# Altium schematic sheet ZYNQ_US_SOC_PL_FPGA_Banks_66_67_68_FMC.SchDoc
size 419 x 296 mm
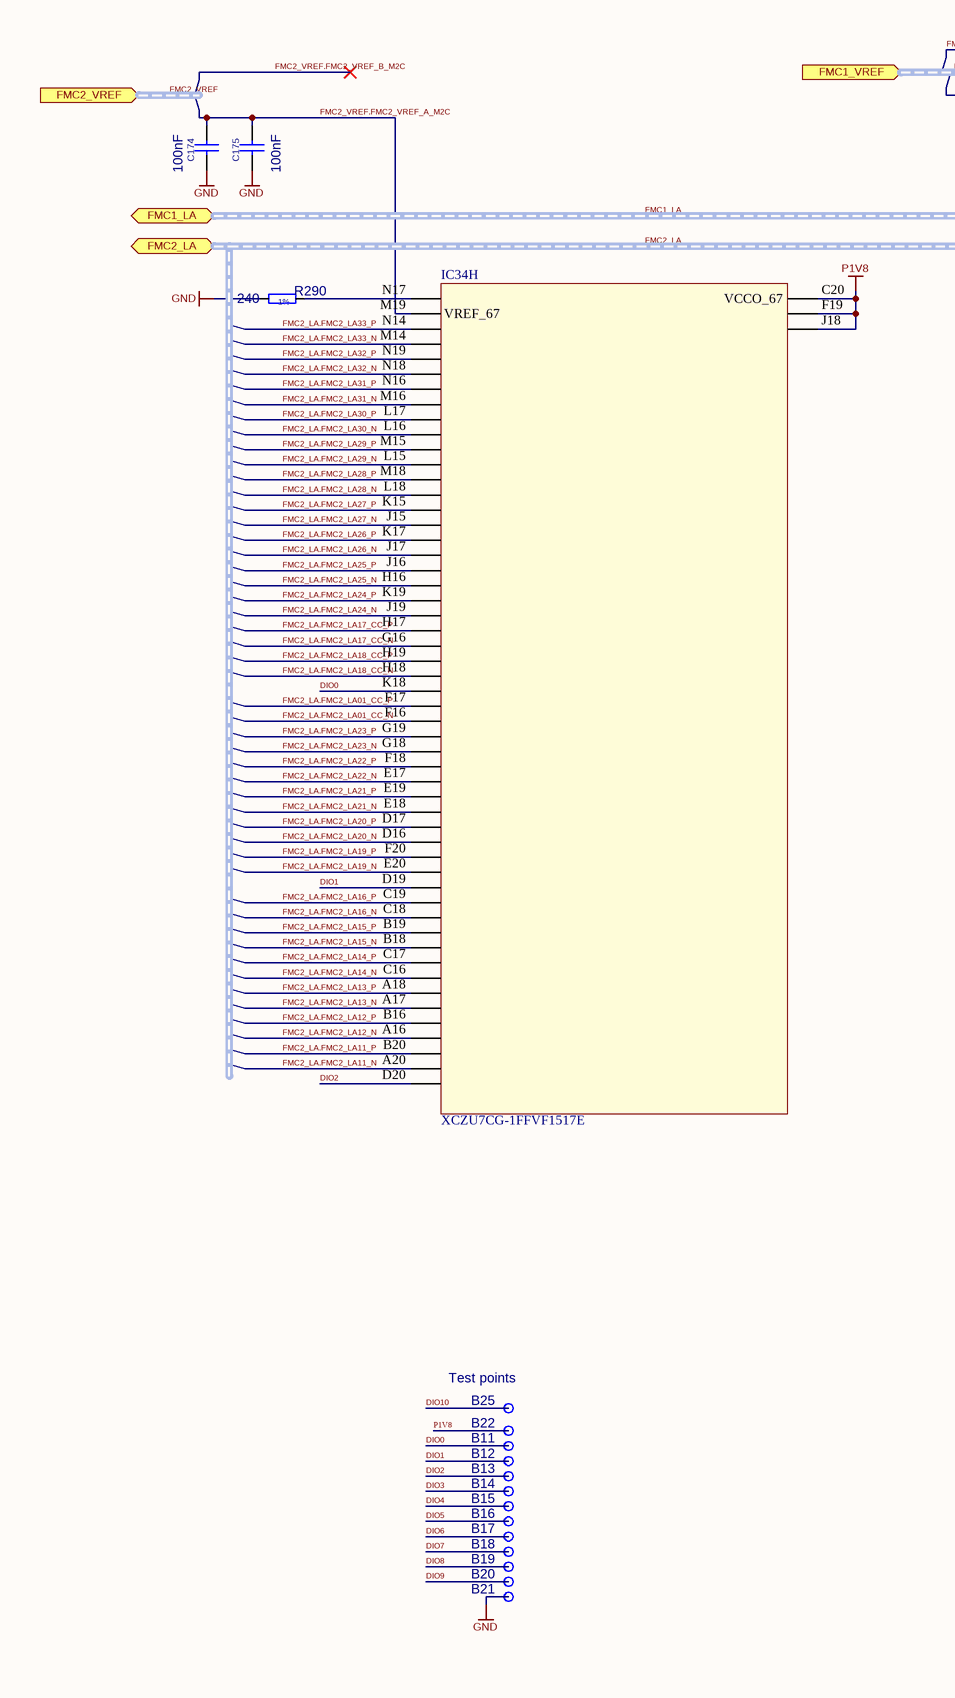
[diagram p0: ZYNQ_US_SOC_PL_FPGA_Banks_66_67_68_FMC.SchDoc, left]
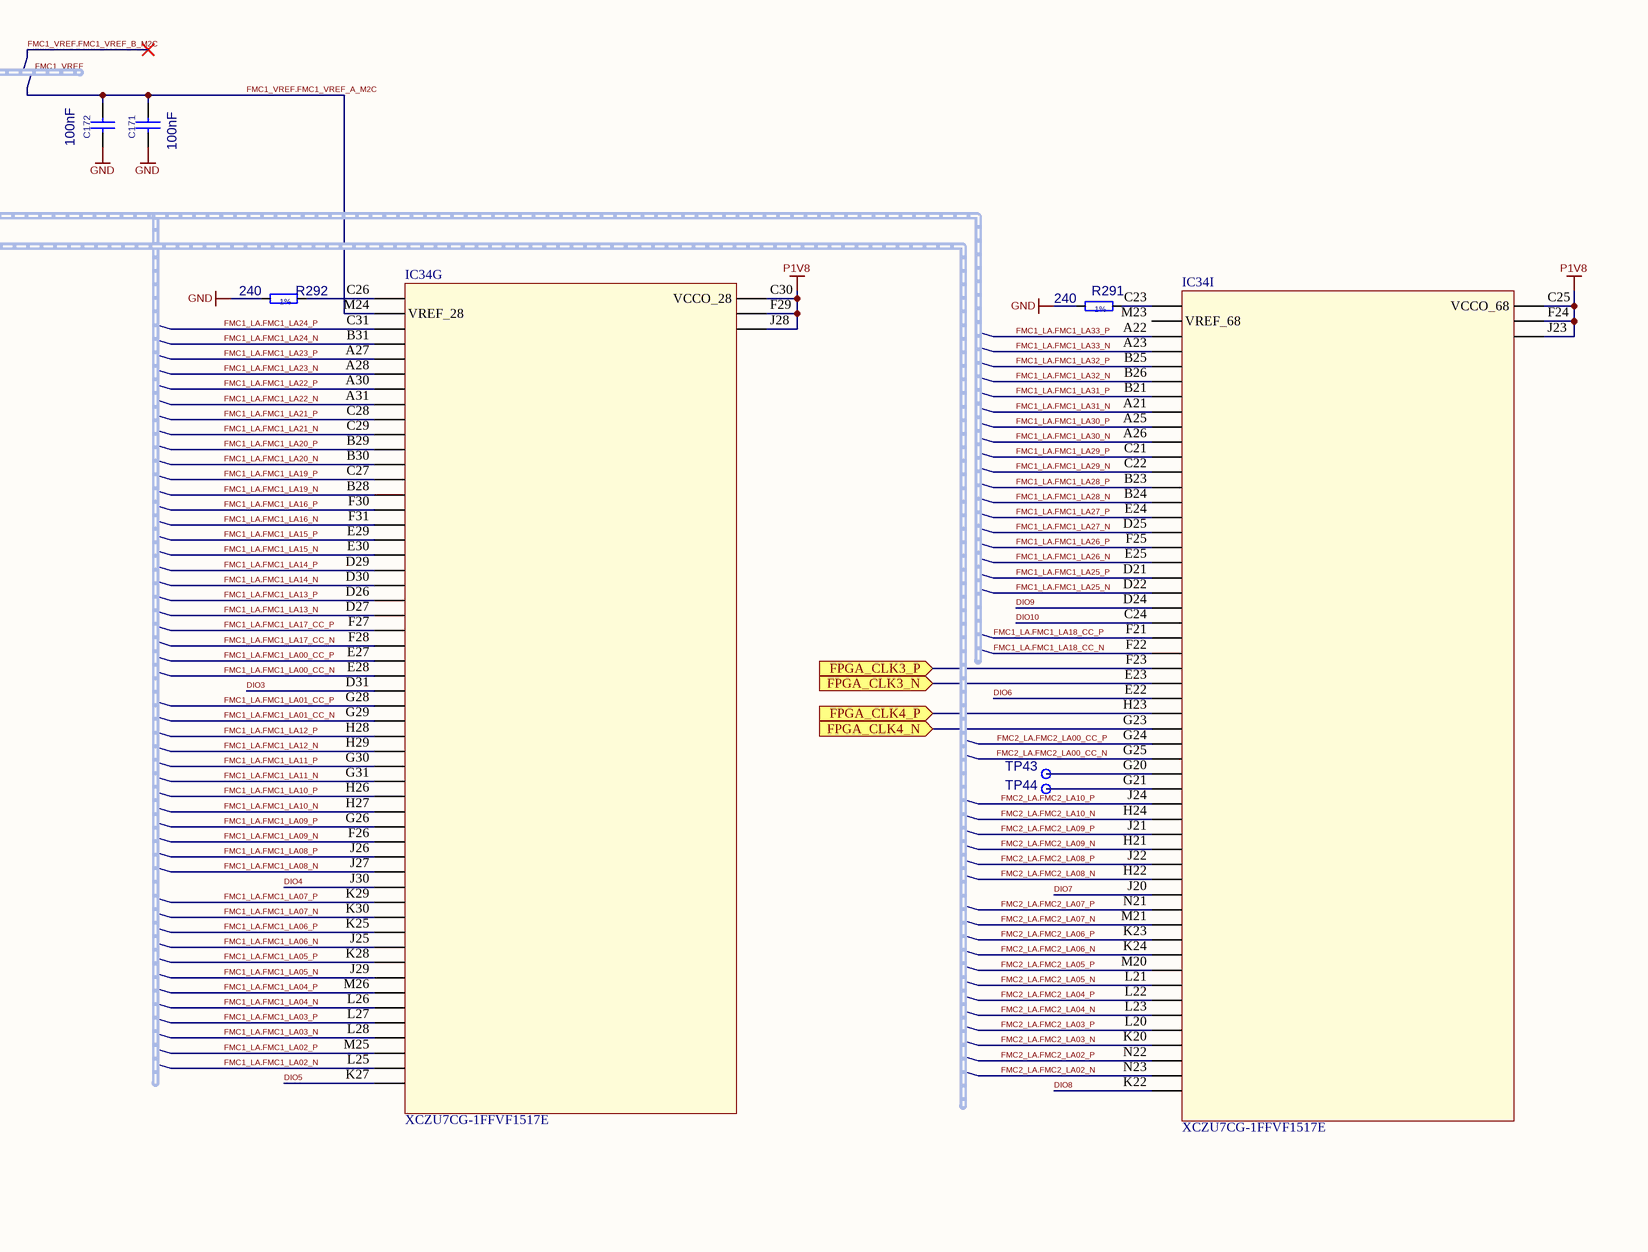
[diagram p1: ZYNQ_US_SOC_PL_FPGA_Banks_66_67_68_FMC.SchDoc, right]

## Parts
B11  SMD_PAD_D1MM  [C100]  (value not drawn)
B12  SMD_PAD_D1MM  [C100]  (value not drawn)
B13  SMD_PAD_D1MM  [C100]  (value not drawn)
B14  SMD_PAD_D1MM  [C100]  (value not drawn)
B15  SMD_PAD_D1MM  [C100]  (value not drawn)
B16  SMD_PAD_D1MM  [C100]  (value not drawn)
B17  SMD_PAD_D1MM  [C100]  (value not drawn)
B18  SMD_PAD_D1MM  [C100]  (value not drawn)
B19  SMD_PAD_D1MM  [C100]  (value not drawn)
B20  SMD_PAD_D1MM  [C100]  (value not drawn)
B21  SMD_PAD_D1MM  [C100]  (value not drawn)
B22  SMD_PAD_D1MM  [C100]  (value not drawn)
B25  SMD_PAD_D1MM  [C100]  (value not drawn)
C171  value 100nF  [CAPC0603X33N]  (hidden comment: Capacitor - non polarized CAPC0603X33N)
C172  value 100nF  [CAPC0603X33N]  (hidden comment: Capacitor - non polarized CAPC0603X33N)
C174  value 100nF  [CAPC0603X33N]  (hidden comment: Capacitor - non polarized CAPC0603X33N)
C175  value 100nF  [CAPC0603X33N]  (hidden comment: Capacitor - non polarized CAPC0603X33N)
IC34  XCZU7CG-1FFVF1517E  (parts G,H,I of 26)
R290  value 240  (hidden comment: Resistor - 1% RESC1005X40N)
R291  value 240  (hidden comment: Resistor - 1% RESC1005X40N)
R292  value 240  (hidden comment: Resistor - 1% RESC1005X40N)
TP43  SMD_PAD_D1MM  [C100]  (value not drawn)
TP44  SMD_PAD_D1MM  [C100]  (value not drawn)

## Ports
FMC1_LA (bidir, harness FMC1_LA), FMC1_VREF (in, harness FMC1_VREF), FMC2_LA (bidir, harness FMC2_LA), FMC2_VREF (in, harness FMC2_VREF), FPGA_CLK3_N (in), FPGA_CLK3_P (in), FPGA_CLK4_N (in), FPGA_CLK4_P (in)

## Nets
GND: B21.1 C171.2 C172.2 C174.2 C175.2 R290.1 R291.1 R292.1
P1V8: B22.1 IC34.C20(VCCO_67) IC34.C25(VCCO_68) IC34.C30(VCCO_28) IC34.F19(VCCO_67_1) IC34.F24(VCCO_68_1) IC34.F29(VCCO_28_1) IC34.J18(VCCO_67_2) IC34.J23(VCCO_68_2) IC34.J28(VCCO_28_2)
DIO0: B11.1 IC34.K18(IOB_X2Y233)
DIO1: B12.1 IC34.D19(IOB_X2Y246)
DIO2: B13.1 IC34.D20(IOB_X2Y259)
DIO3: B14.1 IC34.D31(IOB_X0Y285)
DIO4: B15.1 IC34.J30(IOB_X0Y298)
DIO5: B16.1 IC34.K27(IOB_X0Y311)
DIO6: B17.1 IC34.E22(IOB_X2Y285)
DIO7: B18.1 IC34.J20(IOB_X2Y298)
DIO8: B19.1 IC34.K22(IOB_X2Y311)
DIO9: B20.1 IC34.D24(IOB_X2Y279)
DIO10: B25.1 IC34.C24(IOB_X2Y280)
FMC1_LA.FMC1_LA00_CC_N: IC34.E28(IOB_X0Y284)
FMC1_LA.FMC1_LA00_CC_P: IC34.E27(IOB_X0Y283)
FMC1_LA.FMC1_LA01_CC_N: IC34.G29(IOB_X0Y287)
FMC1_LA.FMC1_LA01_CC_P: IC34.G28(IOB_X0Y286)
FMC1_LA.FMC1_LA02_N: IC34.L25(IOB_X0Y310)
FMC1_LA.FMC1_LA02_P: IC34.M25(IOB_X0Y309)
FMC1_LA.FMC1_LA03_N: IC34.L28(IOB_X0Y308)
FMC1_LA.FMC1_LA03_P: IC34.L27(IOB_X0Y307)
FMC1_LA.FMC1_LA04_N: IC34.L26(IOB_X0Y306)
FMC1_LA.FMC1_LA04_P: IC34.M26(IOB_X0Y305)
FMC1_LA.FMC1_LA05_N: IC34.J29(IOB_X0Y304)
FMC1_LA.FMC1_LA05_P: IC34.K28(IOB_X0Y303)
FMC1_LA.FMC1_LA06_N: IC34.J25(IOB_X0Y302)
FMC1_LA.FMC1_LA06_P: IC34.K25(IOB_X0Y301)
FMC1_LA.FMC1_LA07_N: IC34.K30(IOB_X0Y300)
FMC1_LA.FMC1_LA07_P: IC34.K29(IOB_X0Y299)
FMC1_LA.FMC1_LA08_N: IC34.J27(IOB_X0Y297)
FMC1_LA.FMC1_LA08_P: IC34.J26(IOB_X0Y296)
FMC1_LA.FMC1_LA09_N: IC34.F26(IOB_X0Y295)
FMC1_LA.FMC1_LA09_P: IC34.G26(IOB_X0Y294)
FMC1_LA.FMC1_LA10_N: IC34.H27(IOB_X0Y293)
FMC1_LA.FMC1_LA10_P: IC34.H26(IOB_X0Y292)
FMC1_LA.FMC1_LA11_N: IC34.G31(IOB_X0Y291)
FMC1_LA.FMC1_LA11_P: IC34.G30(IOB_X0Y290)
FMC1_LA.FMC1_LA12_N: IC34.H29(IOB_X0Y289)
FMC1_LA.FMC1_LA12_P: IC34.H28(IOB_X0Y288)
FMC1_LA.FMC1_LA13_N: IC34.D27(IOB_X0Y280)
FMC1_LA.FMC1_LA13_P: IC34.D26(IOB_X0Y279)
FMC1_LA.FMC1_LA14_N: IC34.D30(IOB_X0Y278)
FMC1_LA.FMC1_LA14_P: IC34.D29(IOB_X0Y277)
FMC1_LA.FMC1_LA15_N: IC34.E30(IOB_X0Y276)
FMC1_LA.FMC1_LA15_P: IC34.E29(IOB_X0Y275)
FMC1_LA.FMC1_LA16_N: IC34.F31(IOB_X0Y274)
FMC1_LA.FMC1_LA16_P: IC34.F30(IOB_X0Y273)
FMC1_LA.FMC1_LA17_CC_N: IC34.F28(IOB_X0Y282)
FMC1_LA.FMC1_LA17_CC_P: IC34.F27(IOB_X0Y281)
FMC1_LA.FMC1_LA18_CC_N: IC34.F22(IOB_X2Y282)
FMC1_LA.FMC1_LA18_CC_P: IC34.F21(IOB_X2Y281)
FMC1_LA.FMC1_LA19_N: IC34.B28(IOB_X0Y271)
FMC1_LA.FMC1_LA19_P: IC34.C27(IOB_X0Y270)
FMC1_LA.FMC1_LA20_N: IC34.B30(IOB_X0Y269)
FMC1_LA.FMC1_LA20_P: IC34.B29(IOB_X0Y268)
FMC1_LA.FMC1_LA21_N: IC34.C29(IOB_X0Y267)
FMC1_LA.FMC1_LA21_P: IC34.C28(IOB_X0Y266)
FMC1_LA.FMC1_LA22_N: IC34.A31(IOB_X0Y265)
FMC1_LA.FMC1_LA22_P: IC34.A30(IOB_X0Y264)
FMC1_LA.FMC1_LA23_N: IC34.A28(IOB_X0Y263)
FMC1_LA.FMC1_LA23_P: IC34.A27(IOB_X0Y262)
FMC1_LA.FMC1_LA24_N: IC34.B31(IOB_X0Y261)
FMC1_LA.FMC1_LA24_P: IC34.C31(IOB_X0Y260)
FMC1_LA.FMC1_LA25_N: IC34.D22(IOB_X2Y278)
FMC1_LA.FMC1_LA25_P: IC34.D21(IOB_X2Y277)
FMC1_LA.FMC1_LA26_N: IC34.E25(IOB_X2Y276)
FMC1_LA.FMC1_LA26_P: IC34.F25(IOB_X2Y275)
FMC1_LA.FMC1_LA27_N: IC34.D25(IOB_X2Y274)
FMC1_LA.FMC1_LA27_P: IC34.E24(IOB_X2Y273)
FMC1_LA.FMC1_LA28_N: IC34.B24(IOB_X2Y271)
FMC1_LA.FMC1_LA28_P: IC34.B23(IOB_X2Y270)
FMC1_LA.FMC1_LA29_N: IC34.C22(IOB_X2Y269)
FMC1_LA.FMC1_LA29_P: IC34.C21(IOB_X2Y268)
FMC1_LA.FMC1_LA30_N: IC34.A26(IOB_X2Y267)
FMC1_LA.FMC1_LA30_P: IC34.A25(IOB_X2Y266)
FMC1_LA.FMC1_LA31_N: IC34.A21(IOB_X2Y265)
FMC1_LA.FMC1_LA31_P: IC34.B21(IOB_X2Y264)
FMC1_LA.FMC1_LA32_N: IC34.B26(IOB_X2Y263)
FMC1_LA.FMC1_LA32_P: IC34.B25(IOB_X2Y262)
FMC1_LA.FMC1_LA33_N: IC34.A23(IOB_X2Y261)
FMC1_LA.FMC1_LA33_P: IC34.A22(IOB_X2Y260)
FMC1_VREF.FMC1_VREF_A_M2C: C171.1 C172.1 IC34.M24(VREF_28)
FMC2_LA.FMC2_LA00_CC_N: IC34.G25(IOB_X2Y289)
FMC2_LA.FMC2_LA00_CC_P: IC34.G24(IOB_X2Y288)
FMC2_LA.FMC2_LA01_CC_N: IC34.F16(IOB_X2Y235)
FMC2_LA.FMC2_LA01_CC_P: IC34.F17(IOB_X2Y234)
FMC2_LA.FMC2_LA02_N: IC34.N23(IOB_X2Y310)
FMC2_LA.FMC2_LA02_P: IC34.N22(IOB_X2Y309)
FMC2_LA.FMC2_LA03_N: IC34.K20(IOB_X2Y308)
FMC2_LA.FMC2_LA03_P: IC34.L20(IOB_X2Y307)
FMC2_LA.FMC2_LA04_N: IC34.L23(IOB_X2Y306)
FMC2_LA.FMC2_LA04_P: IC34.L22(IOB_X2Y305)
FMC2_LA.FMC2_LA05_N: IC34.L21(IOB_X2Y304)
FMC2_LA.FMC2_LA05_P: IC34.M20(IOB_X2Y303)
FMC2_LA.FMC2_LA06_N: IC34.K24(IOB_X2Y302)
FMC2_LA.FMC2_LA06_P: IC34.K23(IOB_X2Y301)
FMC2_LA.FMC2_LA07_N: IC34.M21(IOB_X2Y300)
FMC2_LA.FMC2_LA07_P: IC34.N21(IOB_X2Y299)
FMC2_LA.FMC2_LA08_N: IC34.H22(IOB_X2Y297)
FMC2_LA.FMC2_LA08_P: IC34.J22(IOB_X2Y296)
FMC2_LA.FMC2_LA09_N: IC34.H21(IOB_X2Y295)
FMC2_LA.FMC2_LA09_P: IC34.J21(IOB_X2Y294)
FMC2_LA.FMC2_LA10_N: IC34.H24(IOB_X2Y293)
FMC2_LA.FMC2_LA10_P: IC34.J24(IOB_X2Y292)
FMC2_LA.FMC2_LA11_N: IC34.A20(IOB_X2Y258)
FMC2_LA.FMC2_LA11_P: IC34.B20(IOB_X2Y257)
FMC2_LA.FMC2_LA12_N: IC34.A16(IOB_X2Y256)
FMC2_LA.FMC2_LA12_P: IC34.B16(IOB_X2Y255)
FMC2_LA.FMC2_LA13_N: IC34.A17(IOB_X2Y254)
FMC2_LA.FMC2_LA13_P: IC34.A18(IOB_X2Y253)
FMC2_LA.FMC2_LA14_N: IC34.C16(IOB_X2Y252)
FMC2_LA.FMC2_LA14_P: IC34.C17(IOB_X2Y251)
FMC2_LA.FMC2_LA15_N: IC34.B18(IOB_X2Y250)
FMC2_LA.FMC2_LA15_P: IC34.B19(IOB_X2Y249)
FMC2_LA.FMC2_LA16_N: IC34.C18(IOB_X2Y248)
FMC2_LA.FMC2_LA16_P: IC34.C19(IOB_X2Y247)
FMC2_LA.FMC2_LA17_CC_N: IC34.G16(IOB_X2Y230)
FMC2_LA.FMC2_LA17_CC_P: IC34.H17(IOB_X2Y229)
FMC2_LA.FMC2_LA18_CC_N: IC34.H18(IOB_X2Y232)
FMC2_LA.FMC2_LA18_CC_P: IC34.H19(IOB_X2Y231)
FMC2_LA.FMC2_LA19_N: IC34.E20(IOB_X2Y245)
FMC2_LA.FMC2_LA19_P: IC34.F20(IOB_X2Y244)
FMC2_LA.FMC2_LA20_N: IC34.D16(IOB_X2Y243)
FMC2_LA.FMC2_LA20_P: IC34.D17(IOB_X2Y242)
FMC2_LA.FMC2_LA21_N: IC34.E18(IOB_X2Y241)
FMC2_LA.FMC2_LA21_P: IC34.E19(IOB_X2Y240)
FMC2_LA.FMC2_LA22_N: IC34.E17(IOB_X2Y239)
FMC2_LA.FMC2_LA22_P: IC34.F18(IOB_X2Y238)
FMC2_LA.FMC2_LA23_N: IC34.G18(IOB_X2Y237)
FMC2_LA.FMC2_LA23_P: IC34.G19(IOB_X2Y236)
FMC2_LA.FMC2_LA24_N: IC34.J19(IOB_X2Y228)
FMC2_LA.FMC2_LA24_P: IC34.K19(IOB_X2Y227)
FMC2_LA.FMC2_LA25_N: IC34.H16(IOB_X2Y226)
FMC2_LA.FMC2_LA25_P: IC34.J16(IOB_X2Y225)
FMC2_LA.FMC2_LA26_N: IC34.J17(IOB_X2Y224)
FMC2_LA.FMC2_LA26_P: IC34.K17(IOB_X2Y223)
FMC2_LA.FMC2_LA27_N: IC34.J15(IOB_X2Y222)
FMC2_LA.FMC2_LA27_P: IC34.K15(IOB_X2Y221)
FMC2_LA.FMC2_LA28_N: IC34.L18(IOB_X2Y219)
FMC2_LA.FMC2_LA28_P: IC34.M18(IOB_X2Y218)
FMC2_LA.FMC2_LA29_N: IC34.L15(IOB_X2Y217)
FMC2_LA.FMC2_LA29_P: IC34.M15(IOB_X2Y216)
FMC2_LA.FMC2_LA30_N: IC34.L16(IOB_X2Y215)
FMC2_LA.FMC2_LA30_P: IC34.L17(IOB_X2Y214)
FMC2_LA.FMC2_LA31_N: IC34.M16(IOB_X2Y213)
FMC2_LA.FMC2_LA31_P: IC34.N16(IOB_X2Y212)
FMC2_LA.FMC2_LA32_N: IC34.N18(IOB_X2Y211)
FMC2_LA.FMC2_LA32_P: IC34.N19(IOB_X2Y210)
FMC2_LA.FMC2_LA33_N: IC34.M14(IOB_X2Y209)
FMC2_LA.FMC2_LA33_P: IC34.N14(IOB_X2Y208)
FMC2_VREF.FMC2_VREF_A_M2C: C174.1 C175.1 IC34.M19(VREF_67)
FPGA_CLK3_N: IC34.E23(IOB_X2Y284) ; port FPGA_CLK3_N
FPGA_CLK3_P: IC34.F23(IOB_X2Y283) ; port FPGA_CLK3_P
FPGA_CLK4_N: IC34.G23(IOB_X2Y287) ; port FPGA_CLK4_N
FPGA_CLK4_P: IC34.H23(IOB_X2Y286) ; port FPGA_CLK4_P
NetIC34_C23: IC34.C23(IOB_X2Y272) R291.2
NetIC34_C26: IC34.C26(IOB_X0Y272) R292.2
NetIC34_G20: IC34.G20(IOB_X2Y290) TP43.1
NetIC34_G21: IC34.G21(IOB_X2Y291) TP44.1
NetIC34_N17: IC34.N17(IOB_X2Y220) R290.2

Not connected (* = marked no-connect by the designer): IC34 M23(VREF_68)

## Buses and harness runs
harness FMC1_LA = port FMC1_LA
harness FMC1_VREF = port FMC1_VREF
harness FMC2_LA = port FMC2_LA
harness FMC2_VREF = port FMC2_VREF

## Notes on the sheet
- (near B25) Test points
- (in symbol R290) 1%
- (in symbol R291) 1%
- (in symbol R292) 1%

## Library data of the parts
B11 = C100: Part Description: 1mm Diameter SMD Pad; Partition: Pads; CmpIndex: 634; Ref Designator: B11; SymIndex: 2108; Cell Name: C100; PackageDescription: 1mm Diameter SMD Pad; Part Name: SMD_PAD_D1MM; Part Number: SMD_PAD_D1MM; Orientation: 0 = 0
B12 = C100: Part Description: 1mm Diameter SMD Pad; Partition: Pads; CmpIndex: 1220; Ref Designator: B12; SymIndex: 2108; Cell Name: C100; PackageDescription: 1mm Diameter SMD Pad; Part Name: SMD_PAD_D1MM; Part Number: SMD_PAD_D1MM; Orientation: 0 = 0
B13 = C100: Part Description: 1mm Diameter SMD Pad; Partition: Pads; CmpIndex: 1225; Ref Designator: B13; SymIndex: 2108; Cell Name: C100; PackageDescription: 1mm Diameter SMD Pad; Part Name: SMD_PAD_D1MM; Part Number: SMD_PAD_D1MM; Orientation: 0 = 0
B14 = C100: Part Description: 1mm Diameter SMD Pad; Partition: Pads; CmpIndex: 1227; Ref Designator: B14; SymIndex: 2108; Cell Name: C100; PackageDescription: 1mm Diameter SMD Pad; Part Name: SMD_PAD_D1MM; Part Number: SMD_PAD_D1MM; Orientation: 0 = 0
B15 = C100: Part Description: 1mm Diameter SMD Pad; Partition: Pads; CmpIndex: 1228; Ref Designator: B15; SymIndex: 2108; Cell Name: C100; PackageDescription: 1mm Diameter SMD Pad; Part Name: SMD_PAD_D1MM; Part Number: SMD_PAD_D1MM; Orientation: 0 = 0
B16 = C100: Part Description: 1mm Diameter SMD Pad; Partition: Pads; CmpIndex: 1231; Ref Designator: B16; SymIndex: 2108; Cell Name: C100; PackageDescription: 1mm Diameter SMD Pad; Part Name: SMD_PAD_D1MM; Part Number: SMD_PAD_D1MM; Orientation: 0 = 0
B17 = C100: Part Description: 1mm Diameter SMD Pad; Partition: Pads; CmpIndex: 1233; Ref Designator: B17; SymIndex: 2108; Cell Name: C100; PackageDescription: 1mm Diameter SMD Pad; Part Name: SMD_PAD_D1MM; Part Number: SMD_PAD_D1MM; Orientation: 0 = 0
B18 = C100: Part Description: 1mm Diameter SMD Pad; Partition: Pads; CmpIndex: 1234; Ref Designator: B18; SymIndex: 2108; Cell Name: C100; PackageDescription: 1mm Diameter SMD Pad; Part Name: SMD_PAD_D1MM; Part Number: SMD_PAD_D1MM; Orientation: 0 = 0
B19 = C100: Part Description: 1mm Diameter SMD Pad; Partition: Pads; CmpIndex: 1235; Ref Designator: B19; SymIndex: 2108; Cell Name: C100; PackageDescription: 1mm Diameter SMD Pad; Part Name: SMD_PAD_D1MM; Part Number: SMD_PAD_D1MM; Orientation: 0 = 0
B20 = C100: Part Description: 1mm Diameter SMD Pad; Partition: Pads; CmpIndex: 1395; Ref Designator: B20; SymIndex: 2108; Cell Name: C100; PackageDescription: 1mm Diameter SMD Pad; Part Name: SMD_PAD_D1MM; Part Number: SMD_PAD_D1MM; Orientation: 0 = 0
B21 = C100: Part Description: 1mm Diameter SMD Pad; Partition: Pads; CmpIndex: 1396; Ref Designator: B21; SymIndex: 2108; Cell Name: C100; PackageDescription: 1mm Diameter SMD Pad; Part Name: SMD_PAD_D1MM; Part Number: SMD_PAD_D1MM; Orientation: 0 = 0
B22 = C100: Part Description: 1mm Diameter SMD Pad; Partition: Pads; CmpIndex: 1397; Ref Designator: B22; SymIndex: 2108; Cell Name: C100; PackageDescription: 1mm Diameter SMD Pad; Part Name: SMD_PAD_D1MM; Part Number: SMD_PAD_D1MM; Orientation: 0 = 0
B25 = C100: Part Description: 1mm Diameter SMD Pad; Partition: Pads; CmpIndex: 248; Ref Designator: B25; SymIndex: 2108; Cell Name: C100; PackageDescription: 1mm Diameter SMD Pad; Part Name: SMD_PAD_D1MM; Part Number: SMD_PAD_D1MM; Orientation: 0 = 0
C171 = CAPC0603X33N: Capacitor - non polarized CAPC0603X33N 100nF; Manufacturer Part Number: CC0201_100NF_6.3V_10%_X5R; Manufacturer: GENERIC; Part Description: SMD Multilayer Chip Ceramic Capacitor; CmpIndex: 133; DXDB_LIBNAME: Capacitors SMD; Ref Designator: C171; SymIndex: 331; Tolerance: ±10%; Cell Name: CAPC0603X33N; Part Name: Capacitor - non polarized CAPC0603X33N; Part Number: Capacitor - non polarized CAPC0603X33N; Orientation: 3 = 3
C172 = CAPC0603X33N: Capacitor - non polarized CAPC0603X33N 100nF; Manufacturer Part Number: CC0201_100NF_6.3V_10%_X5R; Manufacturer: GENERIC; Part Description: SMD Multilayer Chip Ceramic Capacitor; CmpIndex: 129; DXDB_LIBNAME: Capacitors SMD; Ref Designator: C172; SymIndex: 331; Tolerance: ±10%; Cell Name: CAPC0603X33N; Part Name: Capacitor - non polarized CAPC0603X33N; Part Number: Capacitor - non polarized CAPC0603X33N; Orientation: 3 = 3
C174 = CAPC0603X33N: Capacitor - non polarized CAPC0603X33N 100nF; Manufacturer Part Number: CC0201_100NF_6.3V_10%_X5R; Manufacturer: GENERIC; Part Description: SMD Multilayer Chip Ceramic Capacitor; CmpIndex: 267; DXDB_LIBNAME: Capacitors SMD; Ref Designator: C174; SymIndex: 331; Tolerance: ±10%; Cell Name: CAPC0603X33N; Part Name: Capacitor - non polarized CAPC0603X33N; Part Number: Capacitor - non polarized CAPC0603X33N; Orientation: 3 = 3
C175 = CAPC0603X33N: Capacitor - non polarized CAPC0603X33N 100nF; Manufacturer Part Number: CC0201_100NF_6.3V_10%_X5R; Manufacturer: GENERIC; Part Description: SMD Multilayer Chip Ceramic Capacitor; CmpIndex: 268; DXDB_LIBNAME: Capacitors SMD; Ref Designator: C175; SymIndex: 331; Tolerance: ±10%; Cell Name: CAPC0603X33N; Part Name: Capacitor - non polarized CAPC0603X33N; Part Number: Capacitor - non polarized CAPC0603X33N; Orientation: 3 = 3
R290 = (no symbol name): Resistor - 1% RESC1005X40N 240; Manufacturer Part Number: R0402_240R_1%_0.0625W_100PPM; Manufacturer: GENERIC; Part Description: General Purpose Thick Film Chip Resistor; CmpIndex: 238; DXDB_LIBNAME: Resistors SMD; Ref Designator: R290; SymIndex: 317; Cell Name: RESC1005X40N; Part Name: Resistor - 1% RESC1005X40N; Part Number: Resistor - 1% RESC1005X40N; Tolerance: ±1%; Orientation: 0 = 0
R291 = (no symbol name): Resistor - 1% RESC1005X40N 240; Manufacturer Part Number: R0402_240R_1%_0.0625W_100PPM; Manufacturer: GENERIC; Part Description: General Purpose Thick Film Chip Resistor; DXDB_LIBNAME: Resistors SMD; Ref Designator: R291; SymIndex: 317; Cell Name: RESC1005X40N; CmpIndex: 240; Part Name: Resistor - 1% RESC1005X40N; Part Number: Resistor - 1% RESC1005X40N; Tolerance: ±1%; Orientation: 0 = 0
R292 = (no symbol name): Resistor - 1% RESC1005X40N 240; Manufacturer Part Number: R0402_240R_1%_0.0625W_100PPM; Manufacturer: GENERIC; Part Description: General Purpose Thick Film Chip Resistor; CmpIndex: 131; DXDB_LIBNAME: Resistors SMD; Ref Designator: R292; SymIndex: 317; Cell Name: RESC1005X40N; Part Name: Resistor - 1% RESC1005X40N; Part Number: Resistor - 1% RESC1005X40N; Tolerance: ±1%; Orientation: 0 = 0
TP43 = C100: Part Description: 1mm Diameter SMD Pad; Partition: Pads; CmpIndex: 1400; Ref Designator: TP43; SymIndex: 2108; Cell Name: C100; PackageDescription: 1mm Diameter SMD Pad; Part Name: SMD_PAD_D1MM; Part Number: SMD_PAD_D1MM; Orientation: 0 = 0
TP44 = C100: Part Description: 1mm Diameter SMD Pad; Partition: Pads; CmpIndex: 1401; Ref Designator: TP44; SymIndex: 2108; Cell Name: C100; PackageDescription: 1mm Diameter SMD Pad; Part Name: SMD_PAD_D1MM; Part Number: SMD_PAD_D1MM; Orientation: 0 = 0